# EasyEDA Pro project STM32F407VET6最小系统板.eprj, schematic STM32F407最小系统板_V02
Create Date: 2024-08-08; Page Name: A1; Project Name: STM32F407VET6最小系统板; Schematic Name: STM32F407最小系统板_V02; Update Date: 2024-08-09; Company: 嘉立创EDA; Page Size: A3; Version: V1.0
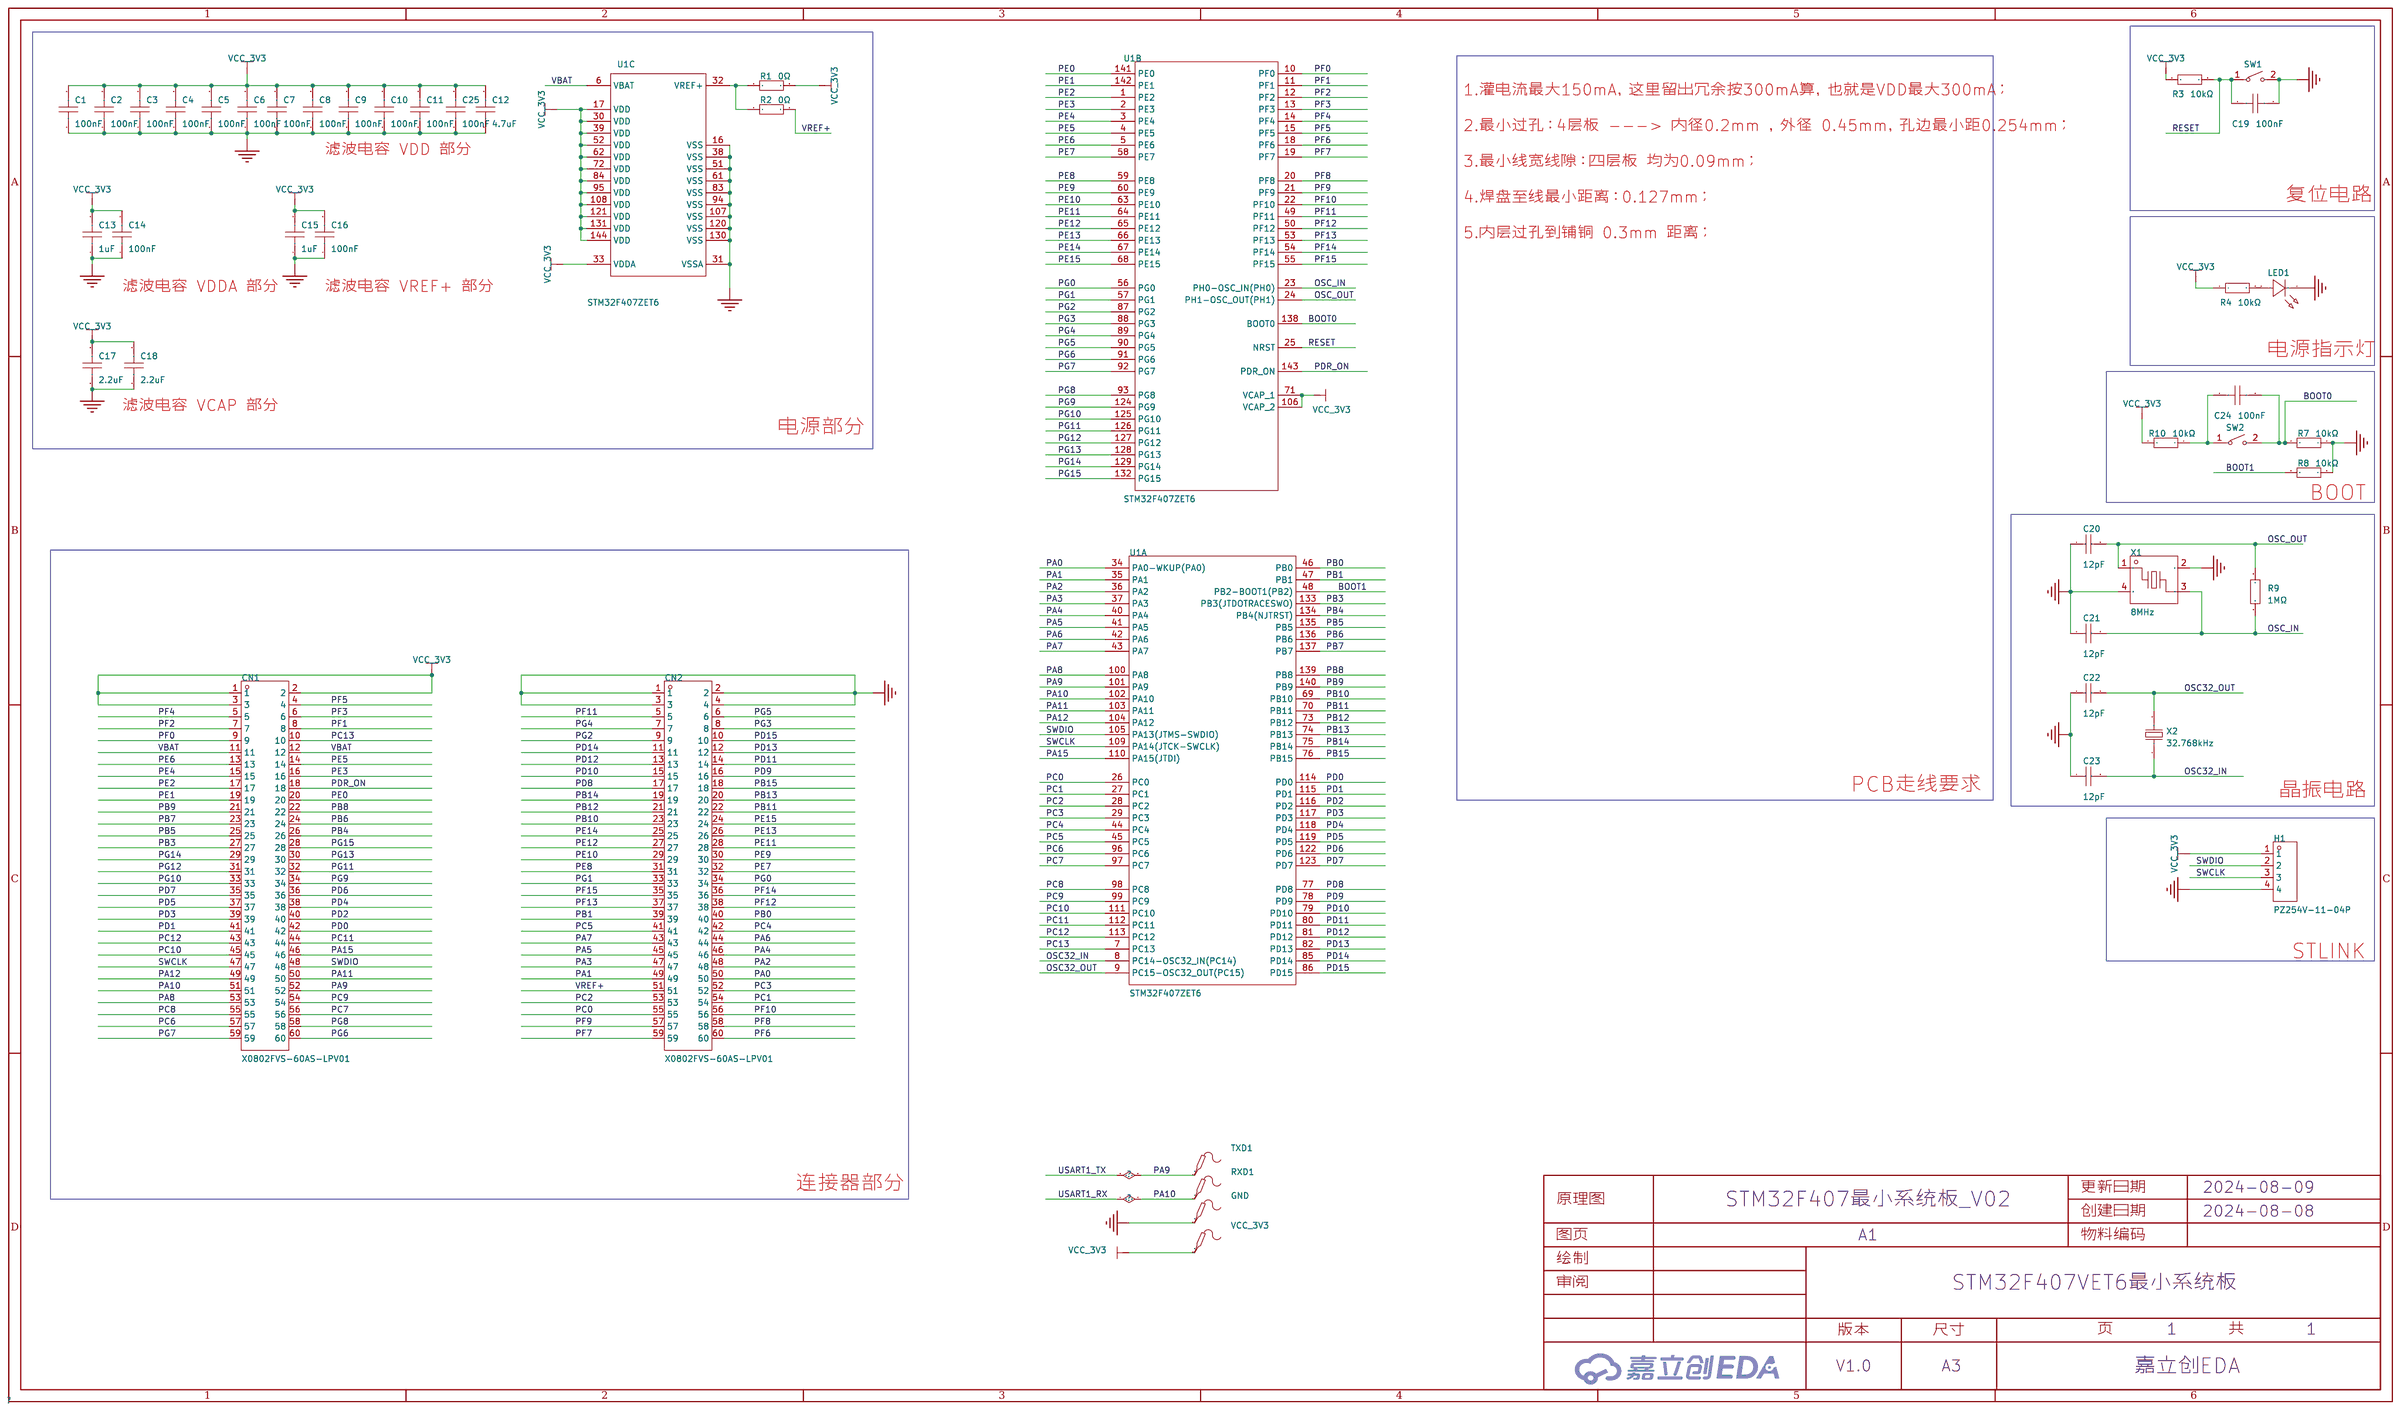
[diagram p0: schematic sheet]

## Parts
C1  100nF  [C0402]
C2  100nF  [C0402]
C3  100nF  [C0402]
C4  100nF  [C0402]
C5  100nF  [C0402]
C6  100nF  [C0402]
C7  100nF  [C0402]
C8  100nF  [C0402]
C9  100nF  [C0402]
C10  100nF  [C0402]
C11  100nF  [C0402]
C12  4.7uF  [C0402]
C13  1uF  [C0402]
C14  100nF  [C0402]
C15  1uF  [C0402]
C16  100nF  [C0402]
C17  2.2uF  [C0402]
C18  2.2uF  [C0402]
C19  100nF  [C0402]
C20  12pF  [C0402]
C21  12pF  [C0402]
C22  12pF  [C0402]
C23  12pF  [C0402]
C24  100nF  [C0402]
C25  100nF  [C0402]
CN1  X0802FVS-60AS-LPV01  [CONN-SMD_60P-P0.80_XKB_X0802FVS-60ADS-LPV01]
CN2  X0802FVS-60AS-LPV01  [CONN-SMD_60P-P0.80_XKB_X0802FVS-60ADS-LPV01]
GND  -  [Test-Point-0.5mm]
H1  PZ254V-11-04P  [HDR-TH_4P-P2.54-V-M]
LED1  XL-1608SURC-06  [LED0603-RD_RED]
R1  0Ω  [R0402]
R2  0Ω  [R0402]
R3  10kΩ  [R0402]
R4  10kΩ  [R0402]
R7  10kΩ  [R0402]
R8  10kΩ  [R0402]
R9  1MΩ  [R0402]
R10  10kΩ  [R0402]
RXD1  -  [Test-Point-0.5mm]
SW1  TS-1088R-02026  [SW-SMD_L3.9-W3.0-P4.45]
SW2  TS-1088R-02026  [SW-SMD_L3.9-W3.0-P4.45]
TXD1  -  [Test-Point-0.5mm]
U1  STM32F407ZET6  [LQFP-144_L20.0-W20.0-P0.50-LS22.0-BL]  (sections 1,2,3)
VCC_3V3  -  [Test-Point-0.5mm]
X1  8MHz  [OSC-SMD_4P-L3.2-W2.5-BL]
X2  32.768kHz  [FC-135R_L3.2-W1.5]

## Library data of the parts
C1-C11 C14 C16 C19 C24 C25 = GRM155R71H104KE14D: 容值:100nF;精度:±10%;额定电压:50V;材质(温度系数):X7R;; LCSC Part Name: 100nF ±10% 50V; Supplier Part: C77020; Manufacturer: muRata(村田); Supplier Footprint: 0402; JLCPCB Part Class: 扩展库; Datasheet: https://atta.szlcsc.com/upload/public/pdf/source/20180326/C77020_39BD49C951FF1AF0DB1F1FAC5AC1E401.pdf; Supplier: LCSC; Tolerance: ±10%; Voltage Rated: 50V; Temperature Coefficient: X7R
C12 = CL05A475KP5NRNC: 容值:4.7uF;精度:±10%;额定电压:10V;材质(温度系数):X5R;; LCSC Part Name: 4.7uF ±10% 10V; Supplier Part: C368809; Manufacturer: SAMSUNG(三星); Supplier Footprint: 0402; JLCPCB Part Class: 扩展库; Datasheet: https://atta.szlcsc.com/upload/public/pdf/source/20160218/1457707763339.pdf; Supplier: LCSC; Tolerance: ±10%; Voltage Rated: 10V; Temperature Coefficient: X5R
C13 C15 = CL05A105KA5NQNC: 容值:1uF;精度:±10%;额定电压:25V;材质(温度系数):X5R;; LCSC Part Name: 1uF ±10% 25V; Supplier Part: C52923; Manufacturer: SAMSUNG(三星); Supplier Footprint: 0402; JLCPCB Part Class: 基础库; Datasheet: https://atta.szlcsc.com/upload/public/pdf/source/20160218/1457707763339.pdf; Supplier: LCSC; Tolerance: ±10%; Voltage Rated: 25V; Temperature Coefficient: X5R
C17 C18 = GRM155R61E225KE11D: 容值:2.2uF;精度:±10%;额定电压:25V;材质(温度系数):X5R;; LCSC Part Name: 2.2uF ±10% 25V; Supplier Part: C385032; Manufacturer: muRata(村田); Supplier Footprint: 0402; JLCPCB Part Class: 扩展库; Datasheet: https://atta.szlcsc.com/upload/public/pdf/source/20190531/C385032_AE390FF415271BC6A7223A7F56F516ED.pdf; Supplier: LCSC; Tolerance: ±10%; Voltage Rated: 25V; Temperature Coefficient: X5R
C20-C23 = 0402CG120J500NT: 容值:12pF;精度:±5%;额定电压:50V;材质(温度系数):C0G;; LCSC Part Name: 12pF ±5% 50V; Supplier Part: C1547; Manufacturer: FH(风华); Supplier Footprint: 0402; JLCPCB Part Class: 基础库; Datasheet: https://atta.szlcsc.com/upload/public/pdf/source/20200305/C486355_26A10D38EF8C2A5C37091D0039909270.pdf; Supplier: LCSC; Tolerance: ±5%; Voltage Rated: 50V; Temperature Coefficient: C0G
CN1 CN2 = X0802FVS-60AS-LPV01: PIN总数:60P;间距:0.8mm;公母:母;安装方式:立贴;行数:2;额定电流:500mA;工作温度范围:-25℃~+85℃;; LCSC Part Name: 间距:0.8mm PIN:60P 母 立贴; Supplier Part: C2925332; Manufacturer: XKB Connection(中国星坤); Supplier Footprint: SMD,P=0.8mm; JLCPCB Part Class: 扩展库; Datasheet: https://atta.szlcsc.com/upload/public/pdf/source/20211215/964657FDD52AC7AD7BD4D76A79F09038.pdf; Supplier: LCSC; Number of Pins: 60P; Pitch: 0.8mm; Gender: 母; Mounting Style: 立贴; Number of Rows: 2; Current Rating (Max): 500mA; Operating Temperature Range: -25℃~+85℃
GND RXD1 TXD1 VCC_3V3 = Test-Point: Test Point 测试点
H1 = PZ254V-11-04P: 插针结构:1x4P;间距:2.54mm;行距:-;圆针/方针:方针;安装类型:直插;排数:单排;总PIN位数:4P;额定电流:3A;额定电压:250V;配合针长度:6mm;塑高:2.5mm;端接针长度:3mm;触头材质:-;工作温度范围:-40℃~+105℃;颜色:黑色;; LCSC Part Name: 间距:2.54mm 1x4P 直插 方针; Supplier Part: C2691448; Manufacturer: XFCN(兴飞); Supplier Footprint: 插件,P=2.54mm; JLCPCB Part Class: 扩展库; Datasheet: https://atta.szlcsc.com/upload/public/pdf/source/20200309/C492403_F9F19131791D08044AD4F84F8E751A34.pdf; Supplier: LCSC; Pin Structure: 1x4P; Pitch: 2.54mm; Circluar Pins/Square Pins: 方针; Mounting Type: 直插; Number of Rows: 单排; Number of Pins: 4P; Current Rating (Max): 3A; Voltage Rating (Max): 250V; Length of Mating Pin: 6mm; Insulation Height: 2.5mm; Length of End Connection Pin: 3mm; Operating Temperature Range: -40℃~+105℃; Color: 黑色
LED1 = XL-1608SURC-06: 发光颜色:红色;功率:55mW;正向电流:25mA;主波长:617nm~621nm;透镜颜色:无色透明透镜;色温:-;发光角度:120°;载带方式:正贴;工作温度:-30℃~+85℃;; Supplier Part: C965799; Manufacturer: XINGLIGHT(成兴光); Supplier Footprint: 0603; JLCPCB Part Class: 扩展库; Datasheet: https://atta.szlcsc.com/upload/public/pdf/source/20221102/D860AFDD1CDB02C5A8064103A32707E2.pdf; Supplier: LCSC; Emitted Color: 红色; Power Dissipation: 55mW; Forward Current: 25mA; Dominant Wavelength: 617nm~621nm; Peak Wavelength: 623nm; Lens Color: 无色透明透镜; Viewing Angle: 120°; Mounting Sytle: 正贴; Operating Temperature: -30℃~+85℃
R1 R2 = 0402WGF0000TCE: 电阻类型:厚膜电阻;阻值:0Ω;精度:±1%;功率:62.5mW;最大工作电压:50V;温度系数:±800ppm/℃;; LCSC Part Name: 0Ω ±1% 62.5mW 厚膜电阻; Supplier Part: C17168; Manufacturer: UNI-ROYAL(厚声); Supplier Footprint: 0402; JLCPCB Part Class: 基础库; Datasheet: https://atta.szlcsc.com/upload/public/pdf/source/20200306/C422600_1E6D84923E4A46A82E41ADD87F860B5C.pdf; Supplier: LCSC; Type: 厚膜电阻; Tolerance: ±1%; Power(Watts): 62.5mW; Overload Voltage (Max): 50V; Temperature Coefficient: ±800ppm/℃; Operating Temperature Range: -55℃~+155℃
R3 R4 R7 R8 R10 = RC0402FR-0710KL: 电阻类型:厚膜电阻;阻值:10kΩ;精度:±1%;功率:62.5mW;最大工作电压:50V;温度系数:±100ppm/℃;; LCSC Part Name: 厚膜电阻 10kΩ ±1% 62.5mW; Supplier Part: C60490; Manufacturer: YAGEO(国巨); Supplier Footprint: 0402; JLCPCB Part Class: 扩展库; Datasheet: https://atta.szlcsc.com/upload/public/pdf/source/20170925/C131467_1506321478108990263.pdf; Supplier: LCSC; Type: 厚膜电阻; Tolerance: ±1%; Power(Watts): 62.5mW; Overload Voltage (Max): 50V; Temperature Coefficient: ±100ppm/℃; Operating Temperature Range: -55℃~+155℃
R9 = 0402WGF1004TCE: 电阻类型:厚膜电阻;阻值:1MΩ;精度:±1%;功率:62.5mW;最大工作电压:50V;温度系数:±100ppm/℃;; LCSC Part Name: 1MΩ ±1% 62.5mW 厚膜电阻; Supplier Part: C26083; Manufacturer: UNI-ROYAL(厚声); Supplier Footprint: 0402; JLCPCB Part Class: 基础库; Datasheet: https://atta.szlcsc.com/upload/public/pdf/source/20200306/C422600_1E6D84923E4A46A82E41ADD87F860B5C.pdf; Supplier: LCSC; Type: 厚膜电阻; Tolerance: ±1%; Power(Watts): 62.5mW; Overload Voltage (Max): 50V; Temperature Coefficient: ±100ppm/℃; Operating Temperature Range: -55℃~+155℃
SW1 SW2 = TS-1088R-02026: 电路结构:单刀单掷;按钮形状:圆形按钮;安装方式:立贴;开关长度:3.9mm;开关宽度:2.93mm;开关高度:2mm;触点电流:50mA;额定电压(DC):12V;带灯:-;机械寿命:-;; LCSC Part Name: 3.9*2.93*2mm 立贴 轻触开关; Supplier Part: C455280; Manufacturer: XUNPU(讯普); Supplier Footprint: SMD,3x4mm; JLCPCB Part Class: 扩展库; Datasheet: https://atta.szlcsc.com/upload/public/pdf/source/20191118/C455281_EC5379764BC1462550DF64BBBFEA9579.pdf; Supplier: LCSC; Circuit: 单刀单掷; Actuator Style: 圆形按钮; Mounting Style: 立贴; Switch Length: 3.9mm; Switch Width: 2.93mm; Switch Height: 2mm; Contact Current: 50mA; Voltage Rating (DC): 12V
U1 = STM32F407ZET6: CPU内核:ARM-M4;程序存储容量:512KB;RAM总容量:192KB;GPIO端口数量:114;工作电压范围:1.8V~3.6V;CPU最大主频:168MHz;程序存储器类型:FLASH;; LCSC Part Name: 带DSP和FPU的高性能基础系列ARM Cortex-M4 MCU，具有512 KB Flash、168 MHz CPU、ART加速器、以太网和FSMC; Supplier Part: C36869; Manufacturer: ST(意法半导体); Supplier Footprint: LQFP-144(20x20); JLCPCB Part Class: 扩展库; Datasheet: https://atta.szlcsc.com/upload/public/pdf/source/20160816/1471342957598.pdf; Supplier: LCSC; CPU Core: ARM-M4; Program Storage Size: 512KB; RAM Size: 192KB; GPIO Ports Number: 114; Operating Voltage Range: 1.8V~3.6V; CPU Maximum Speed: 168MHz; Program Memory Type: FLASH; Operating Temperature Range: -40℃~+85℃; ADC (Bit): 12bit; DAC (Bit): 12bit; Universal Serial Bus: 有; Watchdog: 有; Infrared Data Association: 有; Low-Voltage Detect: 有; LCD Module: 有; Direct Memory Access: 有; Internal Oscillator: 有
X1 = X32258MOB4SI: 晶振类型:贴片晶振;频率:8MHz;常温频差:±10ppm;外接负载电容:12pF;频率稳定度(全温):±20ppm;; LCSC Part Name: 8MHz ±10ppm 12pF; Supplier Part: C2682775; Manufacturer: YXC(扬兴晶振); Supplier Footprint: SMD3225-4P; JLCPCB Part Class: 扩展库; Datasheet: https://atta.szlcsc.com/upload/public/pdf/source/20240329/19D5F850207469550BEB00D7DFEDBC7A.pdf; Supplier: LCSC; Crystal Type: 贴片晶振; Normal temperature Frequency Tolerance: ±10ppm; External load capacitor: 12pF; Frequency Stability(Full temperature range): ±20ppm; Equivalent Series Resistance (ESR): 150Ω; Operating Temperature: -40℃~+85℃
X2 = Q13FC13500004_C32346: 晶振类型:贴片晶振;频率:32.768kHz;常温频差:±20ppm;外接负载电容:12.5pF;; LCSC Part Name: 32.768kHz ±20ppm 12.5pF; Supplier Part: C32346; Manufacturer: EPSON(爱普生); Manufacturer Part: Q13FC13500004; Supplier Footprint: SMD3215-2P; JLCPCB Part Class: 基础库; Datasheet: https://atta.szlcsc.com/upload/public/pdf/source/20240418/0E0FF5F0356BA3753F616001439D1416.pdf; Supplier: LCSC; Crystal Type: 贴片晶振; Normal temperature Frequency Tolerance: ±20ppm; External load capacitor: 12.5pF; Equivalent Series Resistance (ESR): 70kΩ; Operating Temperature: -40℃~+85℃

## Nets
GND: C1.1 C2.1 C3.1 C4.1 C5.1 C6.1 C7.1 C8.1 C9.1 C10.1 C11.1 C12.1 C13.1 C14.1 C15.1 C16.1 C17.1 C18.1 C19.2 C20.1 C21.1 C22.1 C23.1 C25.1 CN2.1 CN2.2 CN2.3 CN2.4 GND.1 H1.4 LED1.1(K) R7.1 R8.1 SW1.2 U1.16(VSS) U1.31(VSSA) U1.38(VSS) U1.51(VSS) U1.61(VSS) U1.83(VSS) U1.94(VSS) U1.107(VSS) U1.120(VSS) U1.130(VSS) X1.2(GND) X1.4(GND)
VBAT: CN1.11 CN1.12 U1.6(VBAT)
VCC_3V3: C1.2 C2.2 C3.2 C4.2 C5.2 C6.2 C7.2 C8.2 C9.2 C10.2 C11.2 C12.2 C13.2 C14.2 C15.2 C16.2 C17.2 C18.2 C25.2 CN1.1 CN1.2 CN1.3 H1.1 R1.2 R3.1 R4.1 R10.2 U1.17(VDD) U1.30(VDD) U1.33(VDDA) U1.39(VDD) U1.52(VDD) U1.62(VDD) U1.71(VCAP_1) U1.72(VDD) U1.84(VDD) U1.95(VDD) U1.106(VCAP_2) U1.108(VDD) U1.121(VDD) U1.131(VDD) U1.144(VDD) VCC_3V3.1
BOOT0: C24.2 R7.2 SW2.2 U1.138(BOOT0)
BOOT1: R8.2 U1.48(PB2-BOOT1(PB2))
OSC32_IN: C23.2 U1.8(PC14-OSC32_IN(PC14)) X2.1
OSC32_OUT: C22.2 U1.9(PC15-OSC32_OUT(PC15)) X2.2
OSC_IN: C21.2 R9.1 U1.23(PH0-OSC_IN(PH0)) X1.3
OSC_OUT: C20.2 R9.2 U1.24(PH1-OSC_OUT(PH1)) X1.1
PA0: CN2.50 U1.34(PA0-WKUP(PA0))
PA1: CN2.49 U1.35(PA1)
PA2: CN2.48 U1.36(PA2)
PA3: CN2.47 U1.37(PA3)
PA4: CN2.46 U1.40(PA4)
PA5: CN2.45 U1.41(PA5)
PA6: CN2.44 U1.42(PA6)
PA7: CN2.43 U1.43(PA7)
PA8: CN1.53 U1.100(PA8)
PA9: CN1.52 TXD1.1 U1.101(PA9)
PA10: CN1.51 RXD1.1 U1.102(PA10)
PA11: CN1.50 U1.103(PA11)
PA12: CN1.49 U1.104(PA12)
PA15: CN1.46 U1.110(PA15(JTDI))
PB0: CN2.40 U1.46(PB0)
PB1: CN2.39 U1.47(PB1)
PB3: CN1.27 U1.133(PB3(JTDOTRACESWO))
PB4: CN1.26 U1.134(PB4(NJTRST))
PB5: CN1.25 U1.135(PB5)
PB6: CN1.24 U1.136(PB6)
PB7: CN1.23 U1.137(PB7)
PB8: CN1.22 U1.139(PB8)
PB9: CN1.21 U1.140(PB9)
PB10: CN2.23 U1.69(PB10)
PB11: CN2.22 U1.70(PB11)
PB12: CN2.21 U1.73(PB12)
PB13: CN2.20 U1.74(PB13)
PB14: CN2.19 U1.75(PB14)
PB15: CN2.18 U1.76(PB15)
PC0: CN2.55 U1.26(PC0)
PC1: CN2.54 U1.27(PC1)
PC2: CN2.53 U1.28(PC2)
PC3: CN2.52 U1.29(PC3)
PC4: CN2.42 U1.44(PC4)
PC5: CN2.41 U1.45(PC5)
PC6: CN1.57 U1.96(PC6)
PC7: CN1.56 U1.97(PC7)
PC8: CN1.55 U1.98(PC8)
PC9: CN1.54 U1.99(PC9)
PC10: CN1.45 U1.111(PC10)
PC11: CN1.44 U1.112(PC11)
PC12: CN1.43 U1.113(PC12)
PC13: CN1.10 U1.7(PC13)
PD0: CN1.42 U1.114(PD0)
PD1: CN1.41 U1.115(PD1)
PD2: CN1.40 U1.116(PD2)
PD3: CN1.39 U1.117(PD3)
PD4: CN1.38 U1.118(PD4)
PD5: CN1.37 U1.119(PD5)
PD6: CN1.36 U1.122(PD6)
PD7: CN1.35 U1.123(PD7)
PD8: CN2.17 U1.77(PD8)
PD9: CN2.16 U1.78(PD9)
PD10: CN2.15 U1.79(PD10)
PD11: CN2.14 U1.80(PD11)
PD12: CN2.13 U1.81(PD12)
PD13: CN2.12 U1.82(PD13)
PD14: CN2.11 U1.85(PD14)
PD15: CN2.10 U1.86(PD15)
PDR_ON: CN1.18 U1.143(PDR_ON)
PE0: CN1.20 U1.141(PE0)
PE1: CN1.19 U1.142(PE1)
PE2: CN1.17 U1.1(PE2)
PE3: CN1.16 U1.2(PE3)
PE4: CN1.15 U1.3(PE4)
PE5: CN1.14 U1.4(PE5)
PE6: CN1.13 U1.5(PE6)
PE7: CN2.32 U1.58(PE7)
PE8: CN2.31 U1.59(PE8)
PE9: CN2.30 U1.60(PE9)
PE10: CN2.29 U1.63(PE10)
PE11: CN2.28 U1.64(PE11)
PE12: CN2.27 U1.65(PE12)
PE13: CN2.26 U1.66(PE13)
PE14: CN2.25 U1.67(PE14)
PE15: CN2.24 U1.68(PE15)
PF0: CN1.9 U1.10(PF0)
PF1: CN1.8 U1.11(PF1)
PF2: CN1.7 U1.12(PF2)
PF3: CN1.6 U1.13(PF3)
PF4: CN1.5 U1.14(PF4)
PF5: CN1.4 U1.15(PF5)
PF6: CN2.60 U1.18(PF6)
PF7: CN2.59 U1.19(PF7)
PF8: CN2.58 U1.20(PF8)
PF9: CN2.57 U1.21(PF9)
PF10: CN2.56 U1.22(PF10)
PF11: CN2.5 U1.49(PF11)
PF12: CN2.38 U1.50(PF12)
PF13: CN2.37 U1.53(PF13)
PF14: CN2.36 U1.54(PF14)
PF15: CN2.35 U1.55(PF15)
PG0: CN2.34 U1.56(PG0)
PG1: CN2.33 U1.57(PG1)
PG2: CN2.9 U1.87(PG2)
PG3: CN2.8 U1.88(PG3)
PG4: CN2.7 U1.89(PG4)
PG5: CN2.6 U1.90(PG5)
PG6: CN1.60 U1.91(PG6)
PG7: CN1.59 U1.92(PG7)
PG8: CN1.58 U1.93(PG8)
PG9: CN1.34 U1.124(PG9)
PG10: CN1.33 U1.125(PG10)
PG11: CN1.32 U1.126(PG11)
PG12: CN1.31 U1.127(PG12)
PG13: CN1.30 U1.128(PG13)
PG14: CN1.29 U1.129(PG14)
PG15: CN1.28 U1.132(PG15)
RESET: C19.1 R3.2 SW1.1 U1.25(NRST)
SWCLK: CN1.47 H1.3 U1.109(PA14(JTCK-SWCLK))
SWDIO: CN1.48 H1.2 U1.105(PA13(JTMS-SWDIO))
VREF+: CN2.51 R2.2
$1N6098: R1.1 R2.1 U1.32(VREF+)
$1N10038: LED1.2(A) R4.2
Net-(C24-1): C24.1 R10.1 SW2.1

## Notes on the sheet
- 1.灌电流最大150mA，这里留出冗余按300mA算，也就是VDD最大300mA；
- 2.最小过孔：4层板 ---> 内径0.2mm ，外径 0.45mm，孔边最小距0.254mm；
- 滤波电容 VDD 部分
- 3.最小线宽线隙：四层板 均为0.09mm；
- 4.焊盘至线最小距离：0.127mm；
- 复位电路
- 5.内层过孔到铺铜 0.3mm 距离；
- 滤波电容 VDDA 部分
- 滤波电容 VREF+ 部分
- 电源指示灯
- 滤波电容 VCAP 部分
- 电源部分
- BOOT
- PCB走线要求
- 晶振电路
- STLINK
- 连接器部分
